# EasyEDA Pro project Project_first.eprj, schematic Schematic4
Create Date: 2024-05-14; Page Name: P1; Project Name: Project_first; Schematic Name: Schematic4; Update Date: 2024-05-14; Company: 嘉立创EDA; Page Size: A4; Version: V1.0
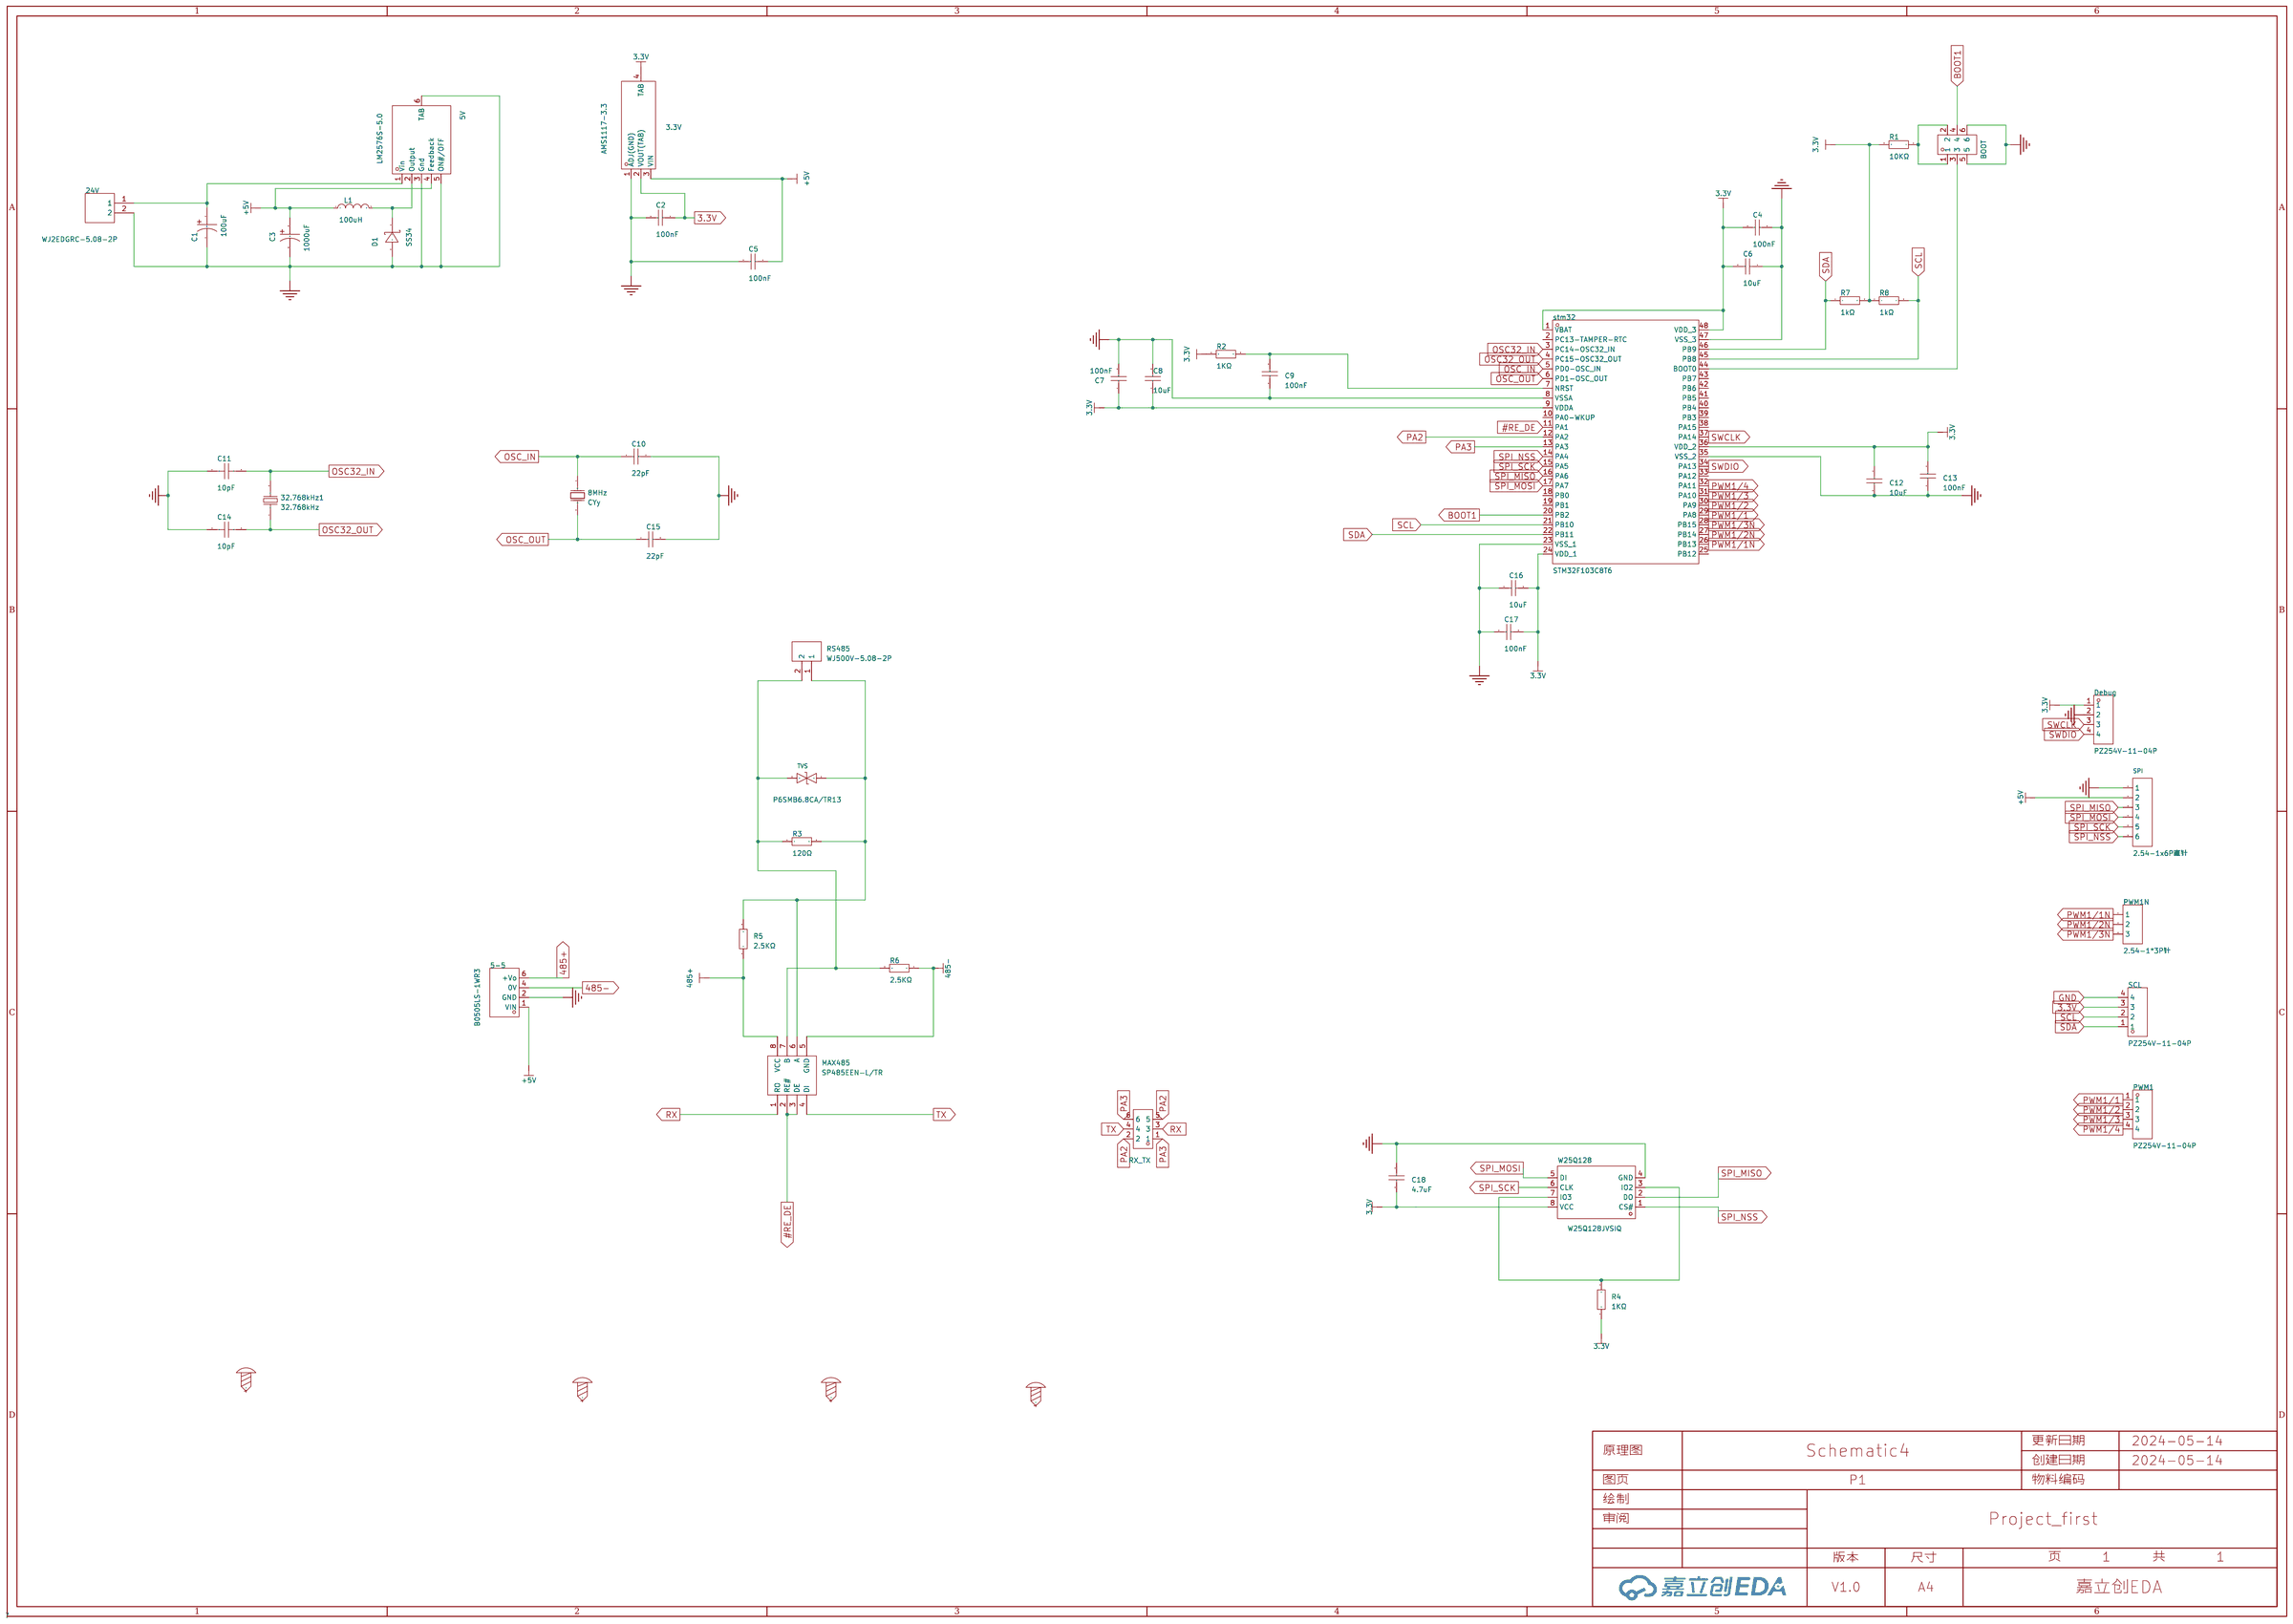
[diagram p3: schematic sheet]

## Parts
3.3V  AMS1117-3.3  [SOT-223-4_L6.5-W3.5-P2.30-LS7.0-BR]
5-5  B0505LS-1WR3  [PWRM-TH_BXXXXLS-1WR3]
5V  LM2576S-5.0  [TO-263-5_L10.2-W8.9-P1.70-BR]
8MHz  CYy  [OSC-TH_L10.0-W4.5-P5.00]
24V  WJ2EDGRC-5.08-2P  [CONN-TH_2P-P5.08_WJ2EDGRC-5.08-2P]
32.768kHz1  32.768kHz  [FC-135R_L3.2-W1.5]
BOOT  PZ254V-12-6P  [HDR-TH_6P-P2.54-V-M-R2-C3-S2.54]
C1  100uF  [CAP-TH_BD8.0-P3.50-D0.6-FD]
C2  100nF  [C1206]
C3  1000uF  [CAP-TH_BD10.0-P5.00-D1.0-FD]
C4  100nF  [C1206]
C5  100nF  [C1206]
C6  10uF  [C1206]
C7  100nF  [C1206]
C8  10uF  [C1206]
C9  100nF  [C1206]
C10  22pF  [C1206]
C11  10pF  [C1206]
C12  10uF  [C1206]
C13  100nF  [C1206]
C14  10pF  [C1206]
C15  22pF  [C1206]
C16  10uF  [C1206]
C17  100nF  [C1206]
C18  4.7uF  [C1206]
D1  SS34  [SMA_L4.3-W2.6-LS5.2-RD]
Debug  PZ254V-11-04P  [HDR-TH_4P-P2.54-V-M]
L1  100uH  [IND-SMD_L7.3-W7.3-1]
MAX485  SP485EEN-L/TR  [SOIC-8_L5.0-W4.0-P1.27-LS6.0-BL]
PWM1  PZ254V-11-04P  [HDR-TH_4P-P2.54-V-M]
PWM1N  2.54-1*3P针  [HDR-TH_3P-P2.54-V-M-1]
R1  10KΩ  [R1206]
R2  1KΩ  [R1206]
R3  120Ω  [R1206]
R4  1KΩ  [R1206]
R5  2.5KΩ  [R1206]
R6  2.5KΩ  [R1206]
R7  1kΩ  [R0805]
R8  1kΩ  [R0805]
RS485  WJ500V-5.08-2P  [CONN-TH_2P-P5.00_WJ500V-5.08-2P]
RX_TX  PZ254V-12-6P  [HDR-TH_6P-P2.54-V-M-R2-C3-S2.54]
SCL  PZ254V-11-04P  [HDR-TH_4P-P2.54-V-M]
SCREW1  -  [M3螺丝]
SCREW2  -  [M3螺丝]
SCREW3  -  [M3螺丝]
SCREW4  -  [M3螺丝]
SPI  2.54-1x6P直针  [HDR-TH_6P-P2.54-V-M-1]
stm32  STM32F103C8T6  [LQFP-48_L7.0-W7.0-P0.50-LS9.0-BL]
TVS  P6SMB6.8CA/TR13  [SMB_L4.6-W3.6-LS5.3-BI]
W25Q128  W25Q128JVSIQ  [SOIC-8_L5.3-W5.3-P1.27-LS8.0-BL]

## Library data of the parts
3.3V = AMS1117-3.3_C347222: 输出类型:固定;最大输入电压:12V;输出电压:3.3V;最大输出电流:1A;电源纹波抑制比(PSRR):60dB@(120Hz);输出极性:正极;; LCSC Part Name: 输出:3.3V 电流:1A 耐压:12V; Supplier Part: C347222; Manufacturer: UMW(友台半导体); Supplier Footprint: SOT-223; JLCPCB Part Class: Extended Part; Datasheet: https://atta.szlcsc.com/upload/public/pdf/source/20231109/155D79A26D9DB04352555A58D5969DC8.pdf; Supplier: LCSC; Output Type: 固定; Maximum Input Voltage: 12V; MAX Output Current: 1A; Power Supply Rejection Ratio (PSRR): 60dB@(120Hz); Dropout Voltage: 1.3V@(1A); Output Polarity: 正极; Number of Outputs: 1; Check: true
5-5 = B0505LS-1WR3_C5365294: 输入电压(DC):4.5V~5.5V;输出电压:5V;输出功率:1W;输出电流(最大值):200mA;; LCSC Part Name: 直流隔离电源模块5V转5V短路保护; Supplier Part: C5365294; Manufacturer: HI-LINK(海凌科); Supplier Footprint: 插件; Supplier: LCSC; Input Voltage(DC): 4.5V~5.5V; Output Voltage: 5V; Output Power: 1W; Output Current (Max): 200mA; Isolation or not: 隔离; Insulated Voltage: 1.5kV; Feature: 短路保护
5V = LM2576S-5.0_C347413: 功能类型:降压型;输出类型:固定;输入电压:40V;输出电压:5V;输出电流(最大值):3A;; Supplier Part: C347413; Manufacturer: UMW(友台半导体); Supplier Footprint: TO-263-5; JLCPCB Part Class: Extended Part; Datasheet: https://atta.szlcsc.com/upload/public/pdf/source/20231109/97ACD99236AD6FA78302E85E1B8CCF74.pdf; Supplier: LCSC; Function: 降压型; Output Type: 固定; Input Voltage: 40V; Output Current (Max): 3A; Switching Frequency: 52kHz; Operating Temperature: -40℃~+125℃@(TA); Synchronous Rectification: 是; Number of Outputs: 1; Topology: 降压式; Switch tube (built-in/external): 内置; Check: true
8MHz = X49SD8MSD2SC: 晶振类型:直插晶振;频率:8MHz;常温频差:±20ppm;外接负载电容:20pF;频率稳定度(全温):±30ppm;; LCSC Part Name: 8MHz ±20ppm 20pF; Supplier Part: C21263; Manufacturer: YXC(扬兴晶振); Supplier Footprint: HC-49S; JLCPCB Part Class: Extended Part; Datasheet: https://atta.szlcsc.com/upload/public/pdf/source/20240329/977D7F2434F98B2BE33270BB9FF3D86D.pdf; Supplier: LCSC; Crystal Type: 直插晶振; Normal temperature Frequency Tolerance: ±20ppm; External load capacitor: 20pF; Frequency Stability(Full temperature range): ±30ppm; Operating Temperature: -20℃~+70℃
24V = WJ2EDGRC-5.08-2P: 连接器类型:板端/插座-闭口;结构:1x2P;间距:5.08mm;颜色:绿色;安装方式:弯针;排数:1;每排PIN数:2;; LCSC Part Name: 5.08mm 1x2P 排数:1 每排P数:2; Supplier Part: C3697; Manufacturer: KANGNEX(康奈克斯电气); Supplier Footprint: 弯插,P=5.08mm; JLCPCB Part Class: Extended Part; Datasheet: https://atta.szlcsc.com/upload/public/pdf/source/20191225/C3697_6E7B45CD3FD3DA2CDF6A2CE707235E10.pdf; Supplier: LCSC; Connector Type: 板端/插座-闭口; Structure: 1x2P; Pitch: 5.08mm; Color: 绿色; Mounting Style: 弯针; Number of Pins: 2P; Number of Rows: 1; Number of PINs Per Row: 2; Check: true
32.768kHz1 = Q13FC13500004_C32346: 晶振类型:贴片晶振;频率:32.768kHz;常温频差:±20ppm;外接负载电容:12.5pF;; LCSC Part Name: 32.768kHz ±20ppm 12.5pF; Supplier Part: C32346; Manufacturer: EPSON(爱普生); Manufacturer Part: Q13FC13500004; Supplier Footprint: SMD3215-2P; JLCPCB Part Class: Basic Part; Datasheet: https://atta.szlcsc.com/upload/public/pdf/source/20240418/0E0FF5F0356BA3753F616001439D1416.pdf; Supplier: LCSC; Crystal Type: 贴片晶振; Normal temperature Frequency Tolerance: ±20ppm; External load capacitor: 12.5pF; Equivalent Series Resistance (ESR): 70kΩ; Operating Temperature: -40℃~+85℃
BOOT RX_TX = PZ254V-12-6P: 插针结构:2x3P;间距:2.54mm;行距:2.54mm;圆针/方针:方针;安装类型:直插;排数:双排;总PIN位数:6P;额定电流:-;额定电压:-;配合针长度:6mm;塑高:2.5mm;端接针长度:3mm;触头材质:黄铜;触头镀层:-;工作温度范围:-40℃~+105℃;颜色:黑色;; LCSC Part Name: 间距:2.54mm 2x3P 直插 方针; Supplier Part: C492420; Manufacturer: XFCN(兴飞); Supplier Footprint: 插件,P=2.54mm; JLCPCB Part Class: Extended Part; Datasheet: https://atta.szlcsc.com/upload/public/pdf/source/20200309/C492420_BAECB307B001054C09D200388220EAE6.pdf; Supplier: LCSC; Pin Structure: 2x3P; Pitch: 2.54mm; Row Spacing: 2.54mm; Circluar Pins/Square Pins: 方针; Mounting Type: 直插; Number of Rows: 双排; Number of Pins: 6P; Length of Mating Pin: 6mm; Insulation Height: 2.5mm; Length of End Connection Pin: 3mm; Contact Material: 黄铜; Operating Temperature Range: -40℃~+105℃; Color: 黑色
C1 = LKMD1401K101MF: 容值:100uF;精度:±20%;额定电压:80V;纹波电流:735mA@100kHz;等效串联电阻:210mΩ@100kHz;; LCSC Part Name: 100uF ±20% 80V; Supplier Part: C443069; Manufacturer: Ymin(永铭); Supplier Footprint: 插件,D8xL14mm; JLCPCB Part Class: Extended Part; Datasheet: https://atta.szlcsc.com/upload/public/pdf/source/20200220/C487520_443A40905984A455D375EE990FEAA9E8.pdf; Supplier: LCSC; Tolerance: ±20%; Rated Voltage: 80V; Ripple Current: 735mA@100kHz; Equivalent Series Resistance(ESR): 210mΩ@100kHz; Lead Spacing: 3.5mm; φD: 8mm; L: 14mm; Lifetime @ Temp: 10000hrs@105℃; Check: true
C2 C4 C5 C7 C9 C13 C17 C18 = CL31B104KBCNNNC: 容值:100nF;精度:±10%;额定电压:50V;材质(温度系数):X7R;; LCSC Part Name: 100nF ±10% 50V; Supplier Part: C24497; Manufacturer: SAMSUNG(三星); Supplier Footprint: 1206; JLCPCB Part Class: Basic Part; Datasheet: https://atta.szlcsc.com/upload/public/pdf/source/20160218/1457707763339.pdf; Supplier: LCSC; Tolerance: ±10%; Voltage Rated: 50V; Temperature Coefficient: X7R
C3 = RC025M102LO10*16TH-2A1E: 容值:1000uF;精度:±20%;额定电压:25V;纹波电流:1.45A@100kHz;; LCSC Part Name: 1000uF ±20% 25V; Supplier Part: C357640; Manufacturer: BERYL(绿宝石); Supplier Footprint: 插件,D10xL16mm; JLCPCB Part Class: Extended Part; Datasheet: https://atta.szlcsc.com/upload/public/pdf/source/20190116/C365813_D032970E50E497412ED095DEE828BCD0.pdf; Supplier: LCSC; Tolerance: ±20%; Rated Voltage: 25V; Ripple Current: 1.45A@100kHz; Lead Spacing: 5mm; φD: 10mm; L: 16mm; Lifetime @ Temp: 3000hrs@105℃; Operating Temperature: -40℃~+105℃; Check: true
C6 C8 C12 C16 = CL31A106KBHNNNE: 容值:10uF;精度:±10%;额定电压:50V;材质(温度系数):X5R;; LCSC Part Name: 10uF ±10% 50V; Supplier Part: C13585; Manufacturer: SAMSUNG(三星); Supplier Footprint: 1206; JLCPCB Part Class: Basic Part; Datasheet: https://atta.szlcsc.com/upload/public/pdf/source/20160218/1457707763339.pdf; Supplier: LCSC; Tolerance: ±10%; Voltage Rated: 50V; Temperature Coefficient: X5R
C10 C15 = 1206CG220J500NT: 容值:22pF;精度:±5%;额定电压:50V;材质(温度系数):C0G;; LCSC Part Name: 22pF ±5% 50V; Supplier Part: C1896; Manufacturer: FH(风华); Supplier Footprint: 1206; JLCPCB Part Class: Extended Part; Datasheet: https://atta.szlcsc.com/upload/public/pdf/source/20200305/C486355_26A10D38EF8C2A5C37091D0039909270.pdf; Supplier: LCSC; Tolerance: ±5%; Voltage Rated: 50V; Temperature Coefficient: C0G
C11 C14 = CC1206FRNPO9BN100: 容值:10pF;精度:±1%;额定电压:50V;材质(温度系数):NP0;; LCSC Part Name: 10pF ±1% 50V; Supplier Part: C541578; Manufacturer: YAGEO(国巨); Supplier Footprint: 1206; JLCPCB Part Class: Extended Part; Datasheet: https://atta.szlcsc.com/upload/public/pdf/source/20200615/C541578_5F432F63CEEF5212108DBC7AE77E6F41.pdf; Supplier: LCSC; Tolerance: ±1%; Voltage Rated: 50V; Temperature Coefficient: NP0
D1 = SS34_C8678: 二极管配置:独立式;正向压降(Vf):550mV@3A;直流反向耐压(Vr):40V;平均整流电流(Io):3A;; LCSC Part Name: 电压:40V 电流:3A; Supplier Part: C8678; Manufacturer: MDD; Supplier Footprint: SMA(DO-214AC); JLCPCB Part Class: Basic Part; Datasheet: https://atta.szlcsc.com/upload/public/pdf/source/20230314/A80AE34493C69B89E2F4B1712F433538.pdf; Supplier: LCSC; Diode Configuration: 独立式; Forward Voltage (Vf@If): 550mV@3A; Reverse Voltage (Vr): 40V; Average Rectified Current (Io): 3A; Reverse Leakage Current (Ir): 500uA@40V; Check: true
Debug PWM1 SCL = PZ254V-11-04P: 插针结构:1x4P;间距:2.54mm;行距:-;圆针/方针:方针;安装类型:直插;排数:单排;总PIN位数:4P;额定电流:3A;额定电压:250V;配合针长度:6mm;塑高:2.5mm;端接针长度:3mm;触头材质:-;工作温度范围:-40℃~+105℃;颜色:黑色;; LCSC Part Name: 间距:2.54mm 1x4P 直插 方针; Supplier Part: C2691448; Manufacturer: XFCN(兴飞); Supplier Footprint: 插件,P=2.54mm; JLCPCB Part Class: Extended Part; Datasheet: https://atta.szlcsc.com/upload/public/pdf/source/20200309/C492403_F9F19131791D08044AD4F84F8E751A34.pdf; Supplier: LCSC; Pin Structure: 1x4P; Pitch: 2.54mm; Circluar Pins/Square Pins: 方针; Mounting Type: 直插; Number of Rows: 单排; Number of Pins: 4P; Current Rating (Max): 3A; Voltage Rating (Max): 250V; Length of Mating Pin: 6mm; Insulation Height: 2.5mm; Length of End Connection Pin: 3mm; Operating Temperature Range: -40℃~+105℃; Color: 黑色
L1 = YPRH0704-101M: 电感值:100uH;精度:±20%;额定电流:600mA;; LCSC Part Name: 100uH ±20%; Supplier Part: C514812; Manufacturer: YJYCOIN(益嘉源); Supplier Footprint: SMD,7.3x7.3mm; JLCPCB Part Class: Extended Part; Datasheet: https://atta.szlcsc.com/upload/public/pdf/source/20200415/C514805_A0DEE7A5C2CBBD84C043B11E55CA01C7.pdf; Supplier: LCSC; Tolerance: ±20%; Rated Current: 600mA; DC Resistance (DCR): 610mΩ; Check: true
MAX485 = SP485EEN-L/TR: 类型:收发器;数据速率:10Mbps;驱动器/接收器:1/1;; LCSC Part Name: 增强型低功耗半双工RS-485收发器; Supplier Part: C6855; Manufacturer: MaxLinear(迈凌); Supplier Footprint: SOIC-8; JLCPCB Part Class: Basic Part; Datasheet: https://atta.szlcsc.com/upload/public/pdf/source/20210125/C916163_66C97B5ACCC910994E8B10780F9BD300.pdf; Supplier: LCSC; Types: 收发器; Supply Voltage: 4.75V~5.25V; Data Rate: 10Mbps; Driver/receiver: 1/1; Operating Temperature: -40℃~+85℃
PWM1N = 2.54-1*3P针: 插针结构:1x3P;间距:2.54mm;行距:-;圆针/方针:方针;安装类型:直插;排数:单排;总PIN位数:3P;额定电流:3A;额定电压:-;配合针长度:-;塑高:-;端接针长度:-;触头材质:-;触头镀层:-;工作温度范围:-40℃~+105℃;颜色:黑色;; LCSC Part Name: 间距:2.54mm 1x3P 直插 方针; Supplier Part: C49257; Manufacturer: BOOMELE(博穆精密); Supplier Footprint: 插件,P=2.54mm; JLCPCB Part Class: Extended Part; Datasheet: https://atta.szlcsc.com/upload/public/pdf/source/20221018/3E9408392E35E6F57A28985E5F7BF5C9.pdf; Supplier: LCSC; Pin Structure: 1x3P; Pitch: 2.54mm; Circluar Pins/Square Pins: 方针; Mounting Type: 直插; Number of Rows: 单排; Number of Pins: 3P; Current Rating (Max): 3A; Operating Temperature Range: -40℃~+105℃; Color: 黑色
R1-R6 = 1206W4F1200T5E: 电阻类型:厚膜电阻;阻值:120Ω;精度:±1%;功率:250mW;最大工作电压:200V;温度系数:±100ppm/℃;; LCSC Part Name: 120Ω ±1% 250mW 厚膜电阻; Supplier Part: C17909; Manufacturer: UNI-ROYAL(厚声); Supplier Footprint: 1206; JLCPCB Part Class: Basic Part; Datasheet: https://atta.szlcsc.com/upload/public/pdf/source/20200306/C422600_1E6D84923E4A46A82E41ADD87F860B5C.pdf; Supplier: LCSC; Type: 厚膜电阻; Tolerance: ±1%; Power(Watts): 250mW; Overload Voltage (Max): 200V; Temperature Coefficient: ±100ppm/℃; Operating Temperature Range: -55℃~+155℃
R7 R8 = 0805W8F1001T5E: 电阻类型:厚膜电阻;阻值:1kΩ;精度:±1%;功率:125mW;最大工作电压:150V;温度系数:±100ppm/℃;; LCSC Part Name: 1kΩ ±1% 125mW 厚膜电阻; Supplier Part: C17513; Manufacturer: UNI-ROYAL(厚声); Supplier Footprint: 0805; JLCPCB Part Class: Basic Part; Datasheet: https://atta.szlcsc.com/upload/public/pdf/source/20200306/C422600_1E6D84923E4A46A82E41ADD87F860B5C.pdf; Supplier: LCSC; Type: 厚膜电阻; Tolerance: ±1%; Power(Watts): 125mW; Overload Voltage (Max): 150V; Temperature Coefficient: ±100ppm/℃; Operating Temperature Range: -55℃~+155℃
RS485 = WJ500V-5.08-2P: 结构:1x2P;间距:5.08mm;颜色:绿色;安装方式:直插;额定电流:18A;额定电压:250V;排数:1;线规 - AWG:14~30;线规 - 平方毫米:2.5;每排PIN数:2;触头材质:-;触头镀层:-;工作温度范围:-40℃~+105℃;焊接温度(最大值):-;; LCSC Part Name: 1x2P 5.08mm 直插 排数:1 每排P数:2; Supplier Part: C8465; Manufacturer: KANGNEX(康奈克斯电气); Supplier Footprint: 插件,P=5.08mm; JLCPCB Part Class: Extended Part; Datasheet: https://atta.szlcsc.com/upload/public/pdf/source/20191225/C8465_02D34CE5B5B4A53DF5891601D97FA9F4.pdf; Supplier: LCSC; Structure: 1x2P; Pitch: 5.08mm; Color: 绿色; Mounting Style: 直插; Current Rating (Max): 18A; Voltage Rating (Max): 250V; Number of Pins: 2P; Number of Rows: 1; Wire Gauge - AWG: 14~30; Wire Gauge - mm2: 2.5; Number of PINs Per Row: 2; Operating Temperature Range: -40℃~+105℃; Screw Specification: M2.5
SCREW1-SCREW4 = M3螺丝: Supplier Footprint: 插件
SPI = 2.54-1x6P直针: 插针结构:1x6P;间距:2.54mm;行距:-;圆针/方针:方针;安装类型:直插;排数:单排;总PIN位数:6P;额定电流:3A;额定电压:-;配合针长度:-;塑高:-;触头材质:黄铜;触头镀层:-;工作温度范围:-40℃~+105℃;颜色:黑色;; LCSC Part Name: 间距:2.54mm 1x6P 直插 方针; Supplier Part: C37208; Manufacturer: BOOMELE(博穆精密); Supplier Footprint: 插件,P=2.54mm; JLCPCB Part Class: Extended Part; Supplier: LCSC; Pin Structure: 1x6P; Pitch: 2.54mm; Circluar Pins/Square Pins: 方针; Mounting Type: 直插; Number of Rows: 单排; Number of Pins: 6P; Current Rating (Max): 3A; Contact Material: 黄铜; Operating Temperature Range: -40℃~+105℃; Color: 黑色
stm32 = STM32F103C8T6: CPU内核:CM3;程序存储容量:64KB;RAM总容量:20KB;GPIO端口数量:37;工作电压范围:2V~3.6V;CPU最大主频:72MHz;程序存储器类型:FLASH;; LCSC Part Name: STM32F103C8T6 MSL=3; Supplier Part: C8734; Manufacturer: ST(意法半导体); Supplier Footprint: LQFP-48(7x7); JLCPCB Part Class: Extended Part; Datasheet: https://atta.szlcsc.com/upload/public/pdf/source/20220812/8363ACEC51AD55ECEB84799464F7CB85.pdf; Supplier: LCSC; CPU Core: CM3; Program Storage Size: 64KB; RAM Size: 20KB; GPIO Ports Number: 37; Operating Voltage Range: 2V~3.6V; CPU Maximum Speed: 72MHz; Program Memory Type: FLASH; Operating Temperature Range: -40℃~+85℃; ADC (Bit): 12bit; Universal Serial Bus: 有; Peripheral/Function: 看门狗；DMA；看门狗；片载温度传感器; Watchdog: 有; Infrared Data Association: 有; Low-Voltage Detect: 有; Direct Memory Access: 有; Internal Oscillator: 有
TVS = P6SMB6.8CA/TR13: 反向截止电压(Vrwm):5.8V;最大钳位电压:10.5V;峰值脉冲电流(Ipp)@10/1000us:58.1A;峰值脉冲功率(Ppp)@10/1000us:600W;击穿电压:6.45V;; Supplier Part: C78395; Manufacturer: Brightking(君耀电子); Supplier Footprint: SMB(DO-214AA); JLCPCB Part Class: Basic Part; Datasheet: https://atta.szlcsc.com/upload/public/pdf/source/20160709/1468031879762.pdf; Supplier: LCSC; Reverse Stand-Off Voltage (Vrwm): 5.8V; Maximum Clamping Voltage: 10.5V; Peak Pulse Current (Ipp)@10/1000us: 58.1A; Peak Pulse Power Dissipation (Ppp)@10/1000us: 600W; Breakdown Voltage: 6.45V
W25Q128 = W25Q128JVSIQ: 接口类型:-;存储容量:128Mbit;时钟频率(fc):-;; LCSC Part Name: W25Q128JVSIQ 编带; Supplier Part: C97521; Manufacturer: WINBOND(华邦); Supplier Footprint: SOIC-8-208mil; JLCPCB Part Class: Basic Part; Datasheet: https://atta.szlcsc.com/upload/public/pdf/source/20170316/1489627409956.pdf; Supplier: LCSC; Memory Size: 128Mbit

## Nets
3.3V: 3.3V.2(VOUT(TAB)) 3.3V.4(TAB) C2.2 C4.2 C6.2 C7.1 C8.1 C12.1 C13.1 C16.1 C17.1 C18.1 Debug.1 R1.2 R2.1 R4.1 R7.2 R8.1 SCL.3 stm32.1(VBAT) stm32.9(VDDA) stm32.24(VDD_1) stm32.36(VDD_2) stm32.48(VDD_3) W25Q128.8(VCC)
+5V: 3.3V.3(VIN) 5-5.1(VIN) 5V.4(Feedback) C3.1 C5.2 L1.1 SPI.2
GND: 3.3V.1(ADJ(GND)) 5-5.2(GND) 5V.3(Gnd) 5V.5(ON#/OFF) 5V.6(TAB) 24V.2 BOOT.5 BOOT.6 C1.2 C2.1 C3.2 C4.1 C5.1 C6.1 C7.2 C8.2 C9.1 C10.2 C11.1 C12.2 C13.2 C14.1 C15.2 C16.2 C17.2 C18.2 D1.2(A) Debug.2 SCL.4 SPI.1 stm32.8(VSSA) stm32.23(VSS_1) stm32.35(VSS_2) stm32.47(VSS_3) W25Q128.4(GND)
485+: 5-5.6(+Vo) MAX485.8(VCC) R5.1
485-: 5-5.4(0V) MAX485.5(GND) R6.1
#RE_DE: MAX485.2(RE#) MAX485.3(DE) stm32.11(PA1)
BOOT1: BOOT.4 stm32.20(PB2)
OSC32_IN: 32.768kHz1.2 C11.2 stm32.3(PC14-OSC32_IN)
OSC32_OUT: 32.768kHz1.1 C14.2 stm32.4(PC15-OSC32_OUT)
OSC_IN: 8MHz.1(OSC1) C10.1 stm32.5(PD0-OSC_IN)
OSC_OUT: 8MHz.2(OSC2) C15.1 stm32.6(PD1-OSC_OUT)
PA2: RX_TX.2 RX_TX.5 stm32.12(PA2)
PA3: RX_TX.1 RX_TX.6 stm32.13(PA3)
PWM1/1: PWM1.1 stm32.29(PA8)
PWM1/1N: PWM1N.1 stm32.26(PB13)
PWM1/2: PWM1.2 stm32.30(PA9)
PWM1/2N: PWM1N.2 stm32.27(PB14)
PWM1/3: PWM1.3 stm32.31(PA10)
PWM1/3N: PWM1N.3 stm32.28(PB15)
PWM1/4: PWM1.4 stm32.32(PA11)
RX: MAX485.1(RO) RX_TX.3
SCL: R8.2 SCL.2 stm32.21(PB10) stm32.45(PB8)
SDA: R7.1 SCL.1 stm32.22(PB11) stm32.46(PB9)
SPI_MISO: SPI.3 stm32.16(PA6) W25Q128.2(DO)
SPI_MOSI: SPI.4 stm32.17(PA7) W25Q128.5(DI)
SPI_NSS: SPI.6 stm32.14(PA4) W25Q128.1(CS#)
SPI_SCK: SPI.5 stm32.15(PA5) W25Q128.6(CLK)
SWCLK: Debug.3 stm32.37(PA14)
SWDIO: Debug.4 stm32.34(PA13)
TX: MAX485.4(DI) RX_TX.4
$1N457: 5V.2(Output) D1.1(K) L1.2
$1N463: 5V.1(Vin) 24V.1 C1.1
$1N2440: BOOT.1 BOOT.2 R1.1
$1N2451: C9.2 R2.2 stm32.7(NRST)
$1N2487: BOOT.3 stm32.44(BOOT0)
$1N3061: MAX485.7(B) R3.1 R6.2 RS485.2 TVS.2
$1N3062: MAX485.6(A) R3.2 R5.2 RS485.1 TVS.1
$1N3214: R4.2 W25Q128.3(IO2) W25Q128.7(IO3)

Not connected (* = marked no-connect by the designer): SCREW1 1; SCREW2 1; SCREW3 1; SCREW4 1; stm32 2(PC13-TAMPER-RTC) 10(PA0-WKUP) 18(PB0) 19(PB1) 25(PB12) 33(PA12) 38(PA15) 39(PB3) 40(PB4) 41(PB5) 42(PB6) 43(PB7)
